# EasyEDA Pro project STM32F407VET6最小系统板.eprj, board STM32F407最小系统板_V02
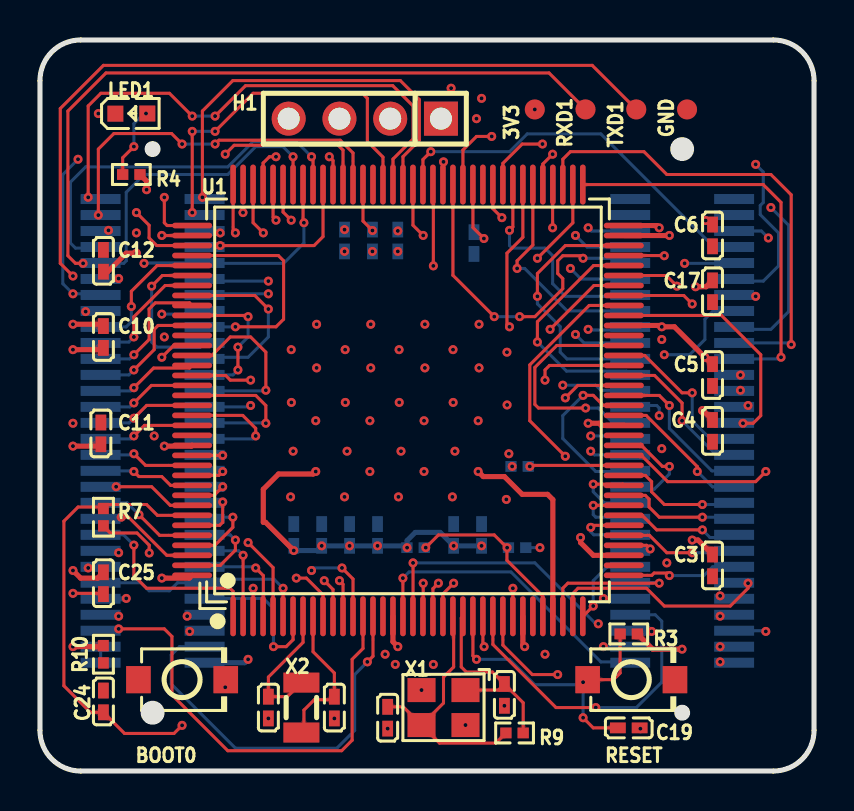
[diagram p2: board, top side]
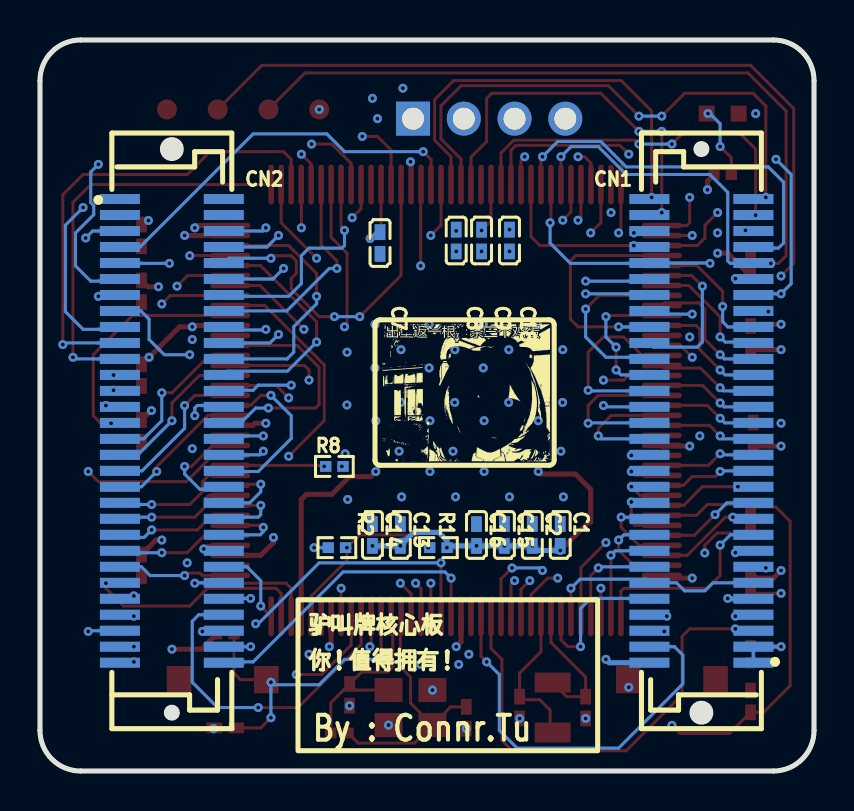
[diagram p3: board, bottom side, seen from below]

Outline 38.73 x 36.58 mm; copper layers: Top Layer, Inner1, Inner2, Bottom Layer. Coordinates in mm from the lower left corner of the outline.
Outline path: 0,34.54 0,2.03 arc(0.6,0.6) 2.03,0 36.7,0 arc(38.14,0.6) 38.73,2.03 38.73,34.54 arc(38.14,35.98) 36.7,36.58 2.03,36.58 arc(0.6,35.98) 0,34.54
Stack: Top Layer 0.035mm 外层铜厚1oz / Dielectric1 0.2104mm 7628 RC49% 8.6mil / Inner1 0.0152mm 内层铜厚 / Dielectric2 1.065mm 1.1mm H/HOZ 含铜 / Inner2 0.0152mm 内层铜厚 / Dielectric3 0.2104mm 7628 RC49% 8.6mil / Bottom Layer 0.035mm 外层铜厚1oz

## Design rules (mm)
template: 自定义配置
spacing copperThickness1oz (default): track to track 0.102, other pairs 0.152 to 0.3
spacing copperThickness2oz: track to track 0.203, other pairs 0.152 to 0.3
track width copperThickness1oz (default): min 0.09, default 0.152, max 2.54
track width copperThickness2oz: min 0.203, default 0.254, max 2.54
differential pair differentialPair (default): width min 0.127, default 0.254, max 2.54; gap min 0.152, default 0.152
via viaSize (default): diameter min 0.45, default 0.45, max 10; hole min 0.2, default 0.2, max 6.299
net GND uses 全铺
net VCC_3V3 uses 全铺
net $1N14408 uses 全铺

## Placement (name value [footprint] x y rotation side)
3V3  -  [test-point-0.5mm]  24.76 33.1 90 top
BOOT0  TS-1088R-02026  [SW-SMD_L3.9-W3.0-P4.45]  7.11 4.57 0 top
C1  100nF  [C0402]  12.7 11.81 270 bottom
C2  100nF  [C0402]  14.1 11.81 270 bottom
C3  100nF  [C0402]  33.66 10.29 90 top
C4  100nF  [C0402]  33.66 17.02 90 top
C5  100nF  [C0402]  33.66 19.81 90 top
C6  100nF  [C0402]  33.66 26.8 90 top
C7  100nF  [C0402]  21.72 26.42 90 bottom
C8  100nF  [C0402]  17.91 26.54 90 bottom
C9  100nF  [C0402]  16.64 26.54 90 bottom
C10  100nF  [C0402]  3.17 21.72 270 top
C11  100nF  [C0402]  3.05 16.89 270 top
C12  4.7uF  [C0402]  3.17 25.53 270 top
C13  1uF  [C0402]  20.7 11.81 270 bottom
C14  100nF  [C0402]  22.1 11.81 270 bottom
C15  1uF  [C0402]  15.49 11.81 270 bottom
C16  100nF  [C0402]  16.89 11.81 270 bottom
C17  2.2uF  [C0402]  33.66 24 90 top
C18  2.2uF  [C0402]  15.24 26.54 90 bottom
C19  100nF  [C0402]  29.46 2.16 0 top
C20  12pF  [C0402]  23.24 3.81 90 top
C21  12pF  [C0402]  17.4 2.67 90 top
C22  12pF  [C0402]  14.73 3.17 90 top
C23  12pF  [C0402]  11.43 3.17 90 top
C24  100nF  [C0402]  3.17 3.48 270 top
C25  100nF  [C0402]  3.17 9.4 90 top
CN1  X0802FVS-60AS-LPV01  [CONN-SMD_60P-P0.80_XKB_X0802FVS-60ADS-LPV01]  5.64 17.02 90 bottom
CN2  X0802FVS-60AS-LPV01  [CONN-SMD_60P-P0.80_XKB_X0802FVS-60ADS-LPV01]  32.14 17.02 270 bottom
GND  -  [test-point-0.5mm]  32.38 33.1 90 top
H1  PZ254V-11-04P  [HDR-TH_4P-P2.54-V-M]  16.26 32.64 180 top
LED1  XL-1608SURC-06  [LED0603-RD_RED]  4.57 32.89 0 top
R1  0Ω  [R0402]  18.8 11.18 180 bottom
R2  0Ω  [R0402]  23.88 11.18 0 bottom
R3  10kΩ  [R0402]  29.46 6.86 180 top
R4  10kΩ  [R0402]  4.57 29.84 180 top
R7  10kΩ  [R0402]  3.17 12.7 90 top
R8  10kΩ  [R0402]  24 15.24 0 bottom
R9  1MΩ  [R0402]  23.75 1.91 0 top
R10  10kΩ  [R0402]  3.17 5.84 90 top
RESET  TS-1088R-02026  [SW-SMD_L3.9-W3.0-P4.45]  29.59 4.57 0 top
RXD1  -  [test-point-0.5mm]  27.3 33.1 90 top
TXD1  -  [test-point-0.5mm]  29.84 33.1 90 top
U1  STM32F407ZET6  [LQFP-144_L20.0-W20.0-P0.50-LS22.0-BL]  18.41 18.54 0 top
X1  8MHz  [OSC-SMD_4P-L3.2-W2.5-BL]  20.19 3.17 180 top
X2  32.768kHz  [FC-135R_L3.2-W1.5]  13.08 3.17 270 top

## Footprints (pads in the part's own frame, mm; a bottom-side part is the same pattern mirrored in y, then rotated)
C0402
  rect 0.79x0.54 smd: 1(-0.545,0) 2(0.545,0)
CONN-SMD_60P-P0.80_XKB_X0802FVS-60ADS-LPV01
  rect 0.5x2 smd: 1(-11.6,-2.6) 2(-11.6,2.6) 3(-10.8,-2.6) 4(-10.8,2.6) 5(-10,-2.6) 6(-10,2.6) 7(-9.2,-2.6) 8(-9.2,2.6) 9(-8.4,-2.6) 10(-8.4,2.6) 11(-7.6,-2.6) 12(-7.6,2.6) 13(-6.8,-2.6) 14(-6.8,2.6) 15(-6,-2.6) 16(-6,2.6) 17(-5.2,-2.6) 18(-5.2,2.6) 19(-4.4,-2.6) 20(-4.4,2.6) 21(-3.6,-2.6) 22(-3.6,2.6) 23(-2.8,-2.6) 24(-2.8,2.6) 25(-2,-2.6) 26(-2,2.6) 27(-1.2,-2.6) 28(-1.2,2.6) 29(-0.4,-2.6) 30(-0.4,2.6) 31(0.4,-2.6) 32(0.4,2.6) 33(1.2,-2.6) 34(1.2,2.6) 35(2,-2.6) 36(2,2.6) 37(2.8,-2.6) 38(2.8,2.6) 39(3.6,-2.6) 40(3.6,2.6) 41(4.4,-2.6) 42(4.4,2.6) 43(5.2,-2.6) 44(5.2,2.6) 45(6,-2.6) 46(6,2.6) 47(6.8,-2.6) 48(6.8,2.6) 49(7.6,-2.6) 50(7.6,2.6) 51(8.4,-2.6) 52(8.4,2.6) 53(9.2,-2.6) 54(9.2,2.6) 55(10,-2.6) 56(10,2.6) 57(10.8,-2.6) 58(10.8,2.6) 59(11.6,-2.6) 60(11.6,2.6)
FC-135R_L3.2-W1.5
  rect 1x1.8 smd: 1(-1.25,0) 2(1.25,0)
HDR-TH_4P-P2.54-V-M
  rect 1.7x1.7 hole 1.1: 1(-3.81,0)
  round 1.7 hole 1.1: 2(-1.27,0) 3(1.27,0) 4(3.81,0)
LED0603-RD_RED
  rect 0.8x0.8 smd: 1(-0.799,-0.004) 2(0.799,0.004)
LQFP-144_L20.0-W20.0-P0.50-LS22.0-BL
  oval 0.28x2 smd: 1(-8.75,-10.8) 2(-8.25,-10.8) 3(-7.75,-10.8) 4(-7.25,-10.8) 5(-6.75,-10.8) 6(-6.25,-10.8) 7(-5.75,-10.8) 8(-5.25,-10.8) 9(-4.75,-10.8) 10(-4.25,-10.8) 11(-3.75,-10.8) 12(-3.25,-10.8) 13(-2.75,-10.8) 14(-2.25,-10.8) 15(-1.75,-10.8) 16(-1.25,-10.8) 17(-0.75,-10.8) 18(-0.25,-10.8) 19(0.25,-10.8) 20(0.75,-10.8) 21(1.25,-10.8) 22(1.75,-10.8) 23(2.25,-10.8) 24(2.75,-10.8) 25(3.25,-10.8) 26(3.75,-10.8) 27(4.25,-10.8) 28(4.75,-10.8) 29(5.25,-10.8) 30(5.75,-10.8) 31(6.25,-10.8) 32(6.75,-10.8) 33(7.25,-10.8) 34(7.75,-10.8) 35(8.25,-10.8) 36(8.75,-10.8) 73(8.75,10.8) 74(8.25,10.8) 75(7.75,10.8) 76(7.25,10.8) 77(6.75,10.8) 78(6.25,10.8) 79(5.75,10.8) 80(5.25,10.8) 81(4.75,10.8) 82(4.25,10.8) 83(3.75,10.8) 84(3.25,10.8) 85(2.75,10.8) 86(2.25,10.8) 87(1.75,10.8) 88(1.25,10.8) 89(0.75,10.8) 90(0.25,10.8) 91(-0.25,10.8) 92(-0.75,10.8) 93(-1.25,10.8) 94(-1.75,10.8) 95(-2.25,10.8) 96(-2.75,10.8) 97(-3.25,10.8) 98(-3.75,10.8) 99(-4.25,10.8) 100(-4.75,10.8) 101(-5.25,10.8) 102(-5.75,10.8) 103(-6.25,10.8) 104(-6.75,10.8) 105(-7.25,10.8) 106(-7.75,10.8) 107(-8.25,10.8) 108(-8.75,10.8)
  oval 2x0.28 smd: 37(10.8,-8.75) 38(10.8,-8.25) 39(10.8,-7.75) 40(10.8,-7.25) 41(10.8,-6.75) 42(10.8,-6.25) 43(10.8,-5.75) 44(10.8,-5.25) 45(10.8,-4.75) 46(10.8,-4.25) 47(10.8,-3.75) 48(10.8,-3.25) 49(10.8,-2.75) 50(10.8,-2.25) 51(10.8,-1.75) 52(10.8,-1.25) 53(10.8,-0.75) 54(10.8,-0.25) 55(10.8,0.25) 56(10.8,0.75) 57(10.8,1.25) 58(10.8,1.75) 59(10.8,2.25) 60(10.8,2.75) 61(10.8,3.25) 62(10.8,3.75) 63(10.8,4.25) 64(10.8,4.75) 65(10.8,5.25) 66(10.8,5.75) 67(10.8,6.25) 68(10.8,6.75) 69(10.8,7.25) 70(10.8,7.75) 71(10.8,8.25) 72(10.8,8.75) 109(-10.8,8.75) 110(-10.8,8.25) 111(-10.8,7.75) 112(-10.8,7.25) 113(-10.8,6.75) 114(-10.8,6.25) 115(-10.8,5.75) 116(-10.8,5.25) 117(-10.8,4.75) 118(-10.8,4.25) 119(-10.8,3.75) 120(-10.8,3.25) 121(-10.8,2.75) 122(-10.8,2.25) 123(-10.8,1.75) 124(-10.8,1.25) 125(-10.8,0.75) 126(-10.8,0.25) 127(-10.8,-0.25) 128(-10.8,-0.75) 129(-10.8,-1.25) 130(-10.8,-1.75) 131(-10.8,-2.25) 132(-10.8,-2.75) 133(-10.8,-3.25) 134(-10.8,-3.75) 135(-10.8,-4.25) 136(-10.8,-4.75) 137(-10.8,-5.25) 138(-10.8,-5.75) 139(-10.8,-6.25) 140(-10.8,-6.75) 141(-10.8,-7.25) 142(-10.8,-7.75) 143(-10.8,-8.25) 144(-10.8,-8.75)
OSC-SMD_4P-L3.2-W2.5-BL
  rect 1.4x1.2 smd: 1(-1.1,-0.875) 2(1.1,-0.875) 3(1.1,0.875) 4(-1.1,0.875)
R0402
  rect 0.566x0.54 smd: 1(-0.433,0) 2(0.433,0)
SW-SMD_L3.9-W3.0-P4.45
  rect 1.23x1.36 smd: 1(-2.185,0) 2(2.185,0)
test-point-0.5mm
  round 1 smd: 1(0,0)

## Nets
As in the schematic, except:
GND: C1.1 C2.1 C3.1 C4.1 C5.1 C6.1 C7.1 C8.1 C9.1 C10.1 C11.1 C12.1 C13.1 C14.1 C15.1 C16.1 C17.1 C18.1 C19.2 C20.1 C21.1 C22.1 C23.1 C25.1 CN2.1 CN2.2 CN2.3 CN2.4 GND.1 H1.4 LED1.1 R7.1 R8.1 RESET.2 U1.16 U1.31 U1.38 U1.51 U1.61 U1.83 U1.94 U1.107 U1.120 U1.130 X1.2 X1.4
VCC_3V3: 3V3.1 C1.2 C2.2 C3.2 C4.2 C5.2 C6.2 C7.2 C8.2 C9.2 C10.2 C11.2 C12.2 C13.2 C14.2 C15.2 C16.2 C17.2 C18.2 C25.2 CN1.1 CN1.2 CN1.3 H1.1 R1.2 R3.1 R4.1 R10.2 U1.17 U1.30 U1.33 U1.39 U1.52 U1.62 U1.71 U1.72 U1.84 U1.95 U1.106 U1.108 U1.121 U1.131 U1.144
BOOT0: BOOT0.2 C24.2 R7.2 U1.138
RESET: C19.1 R3.2 RESET.1 U1.25
$1N14408: BOOT0.1 C24.1 R10.1

## Via types
v1: diameter 0.45, hole 0.2, Top Layer to Bottom Layer, 282 vias

## Routing (per net, layer and track width the routed paths; a pad name or vN(x,y) marks a point on that pad's centre or on a via; arc(x,y) is an arc through that point)
GND: length 6.2
  Top Layer w0.152: C25.1 3.14,8.89 v1(1.65,8.89) ; R7.1 3.17,12.25 3.52,11.91 4.86,11.91 5.47,11.3 v1(5.47,10.91)
  Top Layer w0.254: C10.1 3.09,22.35 v1(1.65,22.35)
  vias: v1(1.65,17.4) v1(2.92,32.89) v1(4.83,26.92) v1(5.72,16.76) v1(6.22,21.72) v1(10.16,27.94) v1(11.43,2.63) v1(12.57,21.08) v1(12.58,18.44) v1(12.54,13.72) v1(12.67,16) v1(14.73,2.63) v1(15.24,26) v1(15.27,21.08) v1(15.28,18.44) v1(15.24,13.72) v1(15.37,16) v1(16.64,26) v1(17.27,5.84) v1(17.4,2.12) v1(17.78,5.33) v1(17.91,26) v1(17.97,21.08) v1(17.98,18.44) v1(17.94,13.72) v1(18.07,16) v1(19.09,4.05) v1(19.69,5.33) v1(20.67,21.08) v1(20.68,18.44) v1(20.64,13.72) v1(20.76,16) v1(21.29,2.3) v1(23.24,3.27) v1(23.37,20.95) v1(23.38,18.31) v1(23.34,13.59) v1(23.46,15.88) v1(23.63,15.24) v1(25.27,5.84) v1(30.04,2.12) v1(31.12,21.59) v1(31.12,16.13) v1(31.37,10.41)
VBAT: length 11.1
  Top Layer w0.152: v1(12.16,9.14) 12.16,7.74
  Bottom Layer w0.152: v1(12.16,9.14) 11.71,9.6 8.42,9.6 8.24,9.42 6.88,9.42 6.48,9.02 5.46,9.02 5.06,9.42 3.04,9.42
VCC_3V3: length 80.5
  Top Layer w0.152: U1.108 9.66,27.04 v1(9.78,26.92) ; 7.62,21.29 6.69,21.29 v1(6.1,20.7) ; U1.95 16.16,27.52 v1(16.64,27.04) ; v1(11.18,26.92) 10.66,27.44 U1.106 ; U1.84 21.66,27.19 v1(22.22,26.64)
  Top Layer w0.254: v1(32.81,24.23) 33.34,24.23 C17.2 ; C5.2 33.62,20.36 v1(33.27,20.7) 31.75,22.22 v1(31.12,22.22) 31.05,22.29 U1.62 ; 25.66,7.74 25.66,13.58 25.4,13.84 24.13,13.84 23.24,14.73 22.18,14.73 v1(21.93,14.99) ; R3.1 30.66,6.1 v1(32.13,6.1) ; v1(24.26,6.22) 24.16,6.31 24.16,7.74 ; v1(17.91,6.22) 17.66,6.47 17.66,7.74 ; U1.52 28.09,17.29 27.98,17.4 v1(27.43,17.4) ; C4.2 33.18,18.03 v1(33.16,18.03) ; 7.62,9.79 7.47,9.65 v1(6.1,9.65) ; v1(1.65,21.08) 3.09,21.08 C10.2 ; 7.62,16.29 7.58,16.26 v1(6.22,16.26) ; v1(33.31,27.54) 33.45,27.54 C6.2 ; v1(12.7,11.03) 11.28,12.45 11.18,12.45 11.18,14.1 11.94,14.86 13.67,14.86 v1(13.8,14.99) ; v1(27.05,11.68) 27.05,11.43 27.69,10.79 U1.39 ; v1(1.65,6.22) 3.12,6.22 R10.2 ; v1(30.99,27.18) 30.87,27.29 U1.72 ; v1(31.5,26.8) 31.49,26.79 U1.71 ; C12.2 3.39,24.98 4.32,25.91 v1(4.83,25.91) ; C25.2 2.88,9.65 2.03,9.65 v1(1.65,10.03) ; v1(32.64,11.56) 32.93,11.56 C3.2 ; v1(5.33,29.08) 5.33,29.52 R4.1 ; v1(1.65,16.26) 2.96,16.26 C11.2
  Inner1 w0.254: 30.99,22.86 31.12,22.73 v1(31.12,22.22)
  Bottom Layer w0.152: v1(22.22,26.64) 21.9,26.96 C7.2 ; 3.04,5.42 CN1.3 3.03,6.22 v1(1.65,6.22)
  Bottom Layer w0.254: v1(10.41,5.59) 10.24,5.42 8.24,5.42 ; v1(18.37,11.18) 18.37,11.53 18.78,11.94 20.03,11.94 v1(20.7,11.27) v1(22.1,11.27) ; R1.2 18.27,11.27 v1(16.89,11.27) v1(15.49,11.27) v1(14.1,11.27) 13.86,11.03 v1(12.7,11.03)
  vias: v1(13.84,22.35) v1(13.84,20.17) v1(13.8,17.53) v1(15.24,27.09) v1(16.55,22.35) v1(16.55,20.17) v1(16.51,17.53) v1(16.51,14.99) v1(17.91,27.02) v1(19.26,22.35) v1(19.26,20.17) v1(19.22,17.53) v1(19.22,14.99) v1(20.57,34.16) v1(21.84,32.64) v1(21.97,22.35) v1(21.97,20.17) v1(21.93,17.53) v1(22.1,33.66) v1(24.76,33.1)
BOOT0: length 26
  Top Layer w0.152: 7.11,2.41 v1(7.11,2.29) 6.71,1.88 4.23,1.88 C24.2 2.52,2.94 1.2,4.26 1.2,12.5 1.91,13.21 3.1,13.21 R7.2 3.38,13.33 5.33,13.33 5.88,12.79 7.62,12.79
  Inner2 w0.254: v1(9.27,4.19) 9.27,3.3 8.25,2.29 v1(7.11,2.29)
BOOT1: length 4.7
  Top Layer w0.152: U1.48 24.56,15.29 v1(24.51,15.24)
OSC32_IN: length 6.7
  Top Layer w0.152: X2.1 12.38,3.72 C23.2 11.43,4.7 13.16,6.43 13.16,7.74
OSC32_OUT: length 7.4
  Top Layer w0.152: 13.66,7.74 13.66,5.97 14.73,4.9 C22.2 14.58,3.57 13.73,3.57 13.21,3.05 13.21,2.05 X2.2
OSC_IN: length 13
  Top Layer w0.152: 20.66,7.74 20.7,7.71 20.7,5.21 20.19,4.7 20.19,3.4 X1.3 ; X1.3 20,1.4 22.81,1.4 R9.1 ; X1.3 18.18,3.21 C21.2
OSC_OUT: length 10
  Top Layer w0.152: 21.16,7.74 21.08,7.66 21.08,5.21 21.34,4.95 22.64,4.95 C20.2 ; C20.2 24.18,3.41 R9.2 ; C20.2 22.94,4.05 X1.1
PA0: length 7.5
  Top Layer w0.152: 30.73,9.4 26.42,9.4 26.16,9.15 26.16,7.74
  Bottom Layer w0.152: v1(30.99,9.4) 30.97,9.42 29.54,9.42
PA1: length 11
  Top Layer w0.152: v1(35.43,9.4) 35.43,9.14 34.54,8.25 31.24,8.25 30.35,9.14 26.92,9.14 26.66,8.88 26.66,7.74
PA2: length 4.2
  Top Layer w0.152: v1(27.69,8.25) 27.18,7.75 27.18,7.73 27.16,7.74
  Bottom Layer w0.152: CN2.48 28.38,10.22 27.69,9.52 v1(27.69,8.25)
PA3: length 5.8
  Top Layer w0.152: U1.37 30.62,9.79 30.73,9.91 31.37,9.91 v1(31.5,9.78)
  Bottom Layer w0.152: CN2.47 33.66,10.22 33.22,9.78 v1(31.5,9.78)
PA4: length 2.4
  Top Layer w0.152: 30.48,11.18 30.36,11.29 U1.40
  Bottom Layer w0.152: v1(30.54,11.11) 30.44,11.02 CN2.46
PA5: length 5.9
  Top Layer w0.152: U1.41 30.5,11.79 31.37,10.92 v1(32.64,10.92)
  Bottom Layer w0.152: v1(32.64,10.92) 34.64,10.92 CN2.45
PA6: length 4
  Top Layer w0.152: U1.42 27.66,12.29 v1(27.56,12.19)
  Bottom Layer w0.152: CN2.44 27.71,11.82 27.56,11.97 v1(27.56,12.19)
PA7: length 6
  Top Layer w0.152: U1.43 30.13,12.79 30.86,12.06 v1(33.15,12.06)
  Bottom Layer w0.152: CN2.43 34.6,11.68 33.53,11.68 v1(33.15,12.06)
PA8: length 19.3
  Top Layer w0.152: v1(13.59,30.73) 13.66,30.66 U1.100
  Bottom Layer w0.152: CN1.53 2.98,26.16 1.78,26.16 1.52,26.42 1.52,29.46 2.29,30.23 9.4,30.23 10.67,31.5 12.83,31.5 v1(13.59,30.73)
PA9: length 55.2
  Top Layer w0.152: v1(1.65,24.77) 1.02,25.4 1.02,33.15 3.17,35.31 27.63,35.31 TXD1.1 ; v1(13.21,27.43) 13.16,27.47 U1.101
  Inner1 w0.254: v1(1.65,24.77) 2.41,24 4.04,24 5.21,25.17 v1(5.21,25.4)
  Bottom Layer w0.152: v1(13.21,27.43) 13.21,26.42 12.19,25.4 8.25,25.4 8.24,25.42 5.22,25.42 v1(5.21,25.4)
PA10: length 51.3
  Top Layer w0.152: RXD1.1 25.48,34.92 3.3,34.92 1.4,33.02 1.4,25.78 1.78,25.4 v1(2.16,25.4) ; U1.102 v1(12.66,30.73)
  Bottom Layer w0.152: 3.04,25.42 3.05,25.4 4.19,25.4 4.32,25.53 4.32,28.96 5.21,29.84 9.4,29.84 10.79,31.24 12.16,31.24 v1(12.66,30.73)
PA11: length 8.9
  Top Layer w0.152: v1(12.57,27.56) 12.16,27.97 U1.103
  Inner2 w0.254: v1(11.43,24.51) 11.81,24.51 12.57,25.27 v1(12.57,27.56)
  Bottom Layer w0.152: CN1.50 8.34,24.51 v1(11.43,24.51)
PA12: length 11.8
  Top Layer w0.152: U1.104 11.66,27.7 v1(11.81,27.56)
  Inner2 w0.254: v1(11.81,27.56) 11.81,26.03 10.67,24.89 4.19,24.89 v1(3.94,24.64)
PA15: length 7.7
  Top Layer w0.152: v1(6.1,26.8) 6.1,26.79 7.62,26.79
  Inner1 w0.254: v1(6.1,22.86) v1(6.1,26.8)
  Bottom Layer w0.152: v1(6.1,22.86) 8.08,22.86 CN1.46
PB0: length 4
  Top Layer w0.152: U1.46 29.16,14.35 v1(27.69,14.35)
  Bottom Layer w0.152: v1(27.69,14.35) 27.69,13.97 28.24,13.42 29.54,13.42
PB1: length 6.5
  Top Layer w0.152: v1(33.15,13.33) 31.24,13.33 30.61,13.97 30.61,14.48 30.29,14.79 U1.47
  Bottom Layer w0.152: 34.74,13.42 34.65,13.33 v1(33.15,13.33)
PB3: length 4.8
  Top Layer w0.152: v1(4.7,15.88) 5.28,15.29 7.62,15.29
  Bottom Layer w0.152: CN1.27 4.64,15.82 v1(4.7,15.88)
PB4: length 1.6
  Top Layer w0.152: v1(9.14,14.99) 8.95,14.79 7.62,14.79
PB5: length 4.9
  Top Layer w0.152: v1(4.7,14.99) 4.95,14.73 6.1,14.73 6.54,14.29 7.62,14.29
  Bottom Layer w0.152: v1(4.7,14.99) 4.67,15.02 CN1.25
PB6: length 1.7
  Top Layer w0.152: v1(9.14,14.22) 8.71,13.79 7.62,13.79
PB7: length 4.2
  Top Layer w0.152: 7.62,13.29 6.52,13.29 5.59,14.22 v1(3.81,14.22)
PB8: length 2.6
  Top Layer w0.152: 7.62,12.29 8.99,12.29 9.14,12.45 v1(9.14,13.46)
PB9: length 5.3
  Top Layer w0.152: 7.62,11.79 5.99,11.79 v1(4.95,12.83)
  Bottom Layer w0.152: 3.04,13.42 4.36,13.42 v1(4.95,12.83)
PB10: length 10.9
  Top Layer w0.152: U1.69 31.23,25.79 v1(31.24,25.78)
  Inner1 w0.254: v1(31.24,25.78) 31.37,25.65 31.37,24 32,23.37 32,20.83 33.15,19.69 34.92,19.69 v1(35.05,19.81)
PB11: length 13
  Top Layer w0.152: v1(24.89,23.75) 24.89,24.89 26.29,26.29 U1.70
  Bottom Layer w0.152: v1(24.89,23.75) 24.89,23.37 26.03,22.23 26.03,20.95 26.37,20.62 CN2.22
PB12: length 20.4
  Top Layer w0.152: v1(37.08,20.7) 37.08,28.45 36.19,29.34 U1.73
  Bottom Layer w0.152: CN2.21 37,20.62 v1(37.08,20.7)
PB13: length 11.9
  Top Layer w0.152: v1(24.89,25.65) 26.66,27.43 U1.74
  Inner2 w0.254: v1(24.89,25.65) 24.89,25.02 26.42,23.49 26.42,22.22 v1(26.8,21.84)
  Bottom Layer w0.152: 29.54,21.42 27.22,21.42 v1(26.8,21.84)
PB14: length 24.1
  Top Layer w0.152: v1(37.59,21.34) 37.59,28.83 36.58,29.84 31.37,29.84 30.23,30.99 26.54,30.99 26.16,30.61 U1.75
  Bottom Layer w0.152: v1(37.59,21.34) 37.51,21.42 34.74,21.42
PB15: length 10.2
  Top Layer w0.152: U1.76 25.65,29.33 v1(25.65,27.18)
  Inner1 w0.254: v1(27.43,22.1) 25.65,23.88 v1(25.65,27.18)
  Bottom Layer w0.152: v1(27.43,22.1) 27.46,22.07 29.38,22.07 CN2.18
PC0: length 20.6
  Top Layer w0.152: 22.16,7.74 22.16,6.35
  Inner2 w0.254: v1(36.32,6.98) 36.32,4.83 35.43,3.94 25.78,3.94 23.62,6.1 22.35,6.1 v1(22.22,6.22)
  Bottom Layer w0.152: v1(36.32,6.98) 36.29,7.02 CN2.55
PC1: length 16.5
  Top Layer w0.152: 22.66,7.74 22.66,6.33 25.82,3.17 v1(27.81,3.17)
  Bottom Layer w0.152: v1(27.81,3.17) 29.84,3.17 31.12,4.44 31.12,7.49 30.79,7.82 CN2.54
PC2: length 14.9
  Top Layer w0.152: 23.16,7.74 23.16,6.3 24.64,4.83 25.78,4.83
  Inner1 w0.254: v1(25.91,4.83) 26.26,5.18 32.36,5.18 33.15,5.97 33.15,7.49 33.4,7.75 v1(34.04,7.75)
PC3: length 7.5
  Top Layer w0.152: 23.66,7.74 v1(23.66,9.14)
  Inner2 w0.254: v1(28.19,8.64) 27.69,9.14 v1(23.66,9.14)
  Bottom Layer w0.152: CN2.52 29.52,8.64 v1(28.19,8.64)
PC4: length 3.9
  Top Layer w0.152: U1.44 v1(27.69,13.29)
  Bottom Layer w0.152: v1(27.69,13.29) 27.69,12.83 27.81,12.7 29.45,12.7 CN2.42
PC5: length 6.2
  Top Layer w0.152: v1(33.15,12.7) 30.99,12.7 30.48,13.21 30.48,13.6 30.29,13.79 U1.45
  Bottom Layer w0.152: v1(33.15,12.7) 34.65,12.7 CN2.41
PC6: length 18.5
  Top Layer w0.152: v1(2.92,27.81) 2.92,31.11 3.7,31.89 6.59,31.89 v1(7.11,31.37) ; v1(8.76,31.37) 8.95,31.56 15.03,31.56 15.66,30.92 U1.96
  Bottom Layer w0.152: v1(7.11,31.37) v1(8.76,31.37)
PC7: length 11.9
  Top Layer w0.152: U1.97 15.16,31.06 14.92,31.31 9.72,31.31 v1(9.27,30.86)
  Inner2 w0.254: v1(9.02,26.92) 9.27,27.18 v1(9.27,30.86)
PC8: length 20.7
  Top Layer w0.152: U1.98 14.66,30.55 v1(14.48,30.73)
  Inner2 w0.254: v1(3.43,27.05) 3.43,32.38 4.83,33.78 13.08,33.78 13.72,33.15 13.72,31.5 v1(14.48,30.73)
PC9: length 7.9
  Top Layer w0.152: U1.99 14.16,26.74 13.72,26.29 v1(9.02,26.29)
PC10: length 15.8
  Top Layer w0.152: 7.62,26.29 5.84,26.29 5.46,26.67 5.46,27.3 v1(4.83,27.94)
  Inner1 w0.254: v1(4.83,27.94) 4.06,27.94 2.54,29.46 1.27,29.46 0.89,29.08 0.89,23.49 1.4,22.99 v1(2.29,22.99)
PC11: length 11.7
  Top Layer w0.152: 7.62,25.79 11.93,25.79 12.19,25.53 12.19,22.61 11.81,22.22 v1(9.78,22.22)
  Bottom Layer w0.152: v1(9.78,22.22) 9.77,22.22 CN1.44
PC12: length 6.7
  Top Layer w0.152: v1(4.57,23.24) 4.57,24 5.86,25.29 7.62,25.29
  Bottom Layer w0.152: CN1.43 4.31,22.22 4.57,22.48 v1(4.57,23.24)
PC13: length 7.9
  Top Layer w0.152: 12.66,7.74 12.66,6.57 12.32,6.22 v1(11.68,6.22)
  Bottom Layer w0.152: v1(11.68,6.22) 11.68,8.13 11.18,8.64 8.25,8.64 CN1.10
PD0: length 7.9
  Top Layer w0.152: 7.62,24.79 6.12,24.79 v1(5.59,24.26)
  Bottom Layer w0.152: v1(5.59,24.26) 5.59,21.46 5.84,21.21 8.03,21.21 8.24,21.42
PD1: length 6.4
  Top Layer w0.152: 7.62,24.29 6.26,24.29 4.7,22.73 v1(4.7,21.72)
  Bottom Layer w0.152: 3.04,21.42 3.08,21.46 4.44,21.46 v1(4.7,21.72)
PD2: length 9.1
  Top Layer w0.152: 7.62,23.79 10.75,23.79 v1(11.43,23.11)
  Bottom Layer w0.152: CN1.40 8.32,20.7 10.41,20.7 11.43,21.72 v1(11.43,23.11)
PD3: length 6.7
  Top Layer w0.152: v1(4.7,20.83) 5.46,21.59 5.46,23.11 5.77,23.42 7.48,23.42 7.62,23.29
  Bottom Layer w0.152: CN1.39 4.49,20.62 v1(4.7,20.83)
PD4: length 7.5
  Top Layer w0.152: v1(10.41,22.73) 10.35,22.79 7.62,22.79 ; v1(9.91,20.07) v1(9.91,21.21)
  Bottom Layer w0.152: v1(9.91,21.21) 10.41,21.72 v1(10.41,22.73) ; CN1.38 9.66,19.82 v1(9.91,20.07)
PD5: length 6.2
  Top Layer w0.152: v1(4.7,20.07) 5.72,21.08 5.72,22.1 5.91,22.29 7.62,22.29
  Bottom Layer w0.152: CN1.37 4.45,19.82 v1(4.7,20.07)
PD6: length 9.4
  Top Layer w0.152: 7.62,20.79 8.6,20.79 9.53,21.72 10.54,21.72 11.3,20.95 v1(11.3,19.05)
  Bottom Layer w0.152: v1(11.3,19.05) 11.27,19.02 CN1.36
PD7: length 5.1
  Top Layer w0.152: v1(4.7,19.18) 5.68,20.16 7.48,20.16 7.62,20.29
  Bottom Layer w0.152: v1(4.7,19.18) 4.54,19.02 CN1.35
PD8: length 22.5
  Top Layer w0.152: v1(25.65,30.86) 25.16,30.37 U1.77
  Inner2 w0.254: v1(36.58,28.19) 34.92,29.84 30.86,29.84 29.84,30.86 v1(25.65,30.86)
  Bottom Layer w0.152: v1(36.58,28.19) 37.47,27.3 37.47,22.99 36.58,22.1 34.86,22.1 CN2.17
PD9: length 11.1
  Top Layer w0.152: v1(23.88,25.15) 23.88,25.53 24.66,26.32 U1.78
  Bottom Layer w0.152: CN2.16 26.38,23.02 24.26,25.15 v1(23.88,25.15)
PD10: length 21.5
  Top Layer w0.152: U1.79 24.16,26.7 23.37,25.91 23.37,22.35 v1(23.5,22.22)
  Inner1 w0.254: v1(23.5,22.22) 23.5,22.13 25.56,20.07 30.48,20.07 v1(31.24,20.83)
  Bottom Layer w0.152: v1(31.24,20.83) 32.51,20.83 33.27,21.59 33.27,22.61 33.69,23.02 CN2.15
PD11: length 11.1
  Top Layer w0.152: v1(23.5,27.05) 23.66,27.22 U1.80
  Bottom Layer w0.152: v1(23.5,27.05) 23.5,26.29 23.62,26.16 25.27,26.16 25.65,25.78 25.65,24.38 26.29,23.75 29.47,23.75 CN2.14
PD12: length 21.5
  Top Layer w0.152: U1.81 23.16,30.4 24.13,31.37 v1(25.15,31.37)
  Inner1 w0.254: v1(35.81,23.75) 35.81,27.05 36.07,27.3 36.07,28.45 34.42,30.09 31.53,30.09 30.25,31.37 v1(25.15,31.37)
  Bottom Layer w0.152: CN2.13 35.75,23.82 v1(35.81,23.75)
PD13: length 9.5
  Top Layer w0.152: v1(23.11,27.69) 22.66,28.13 U1.82
  Inner2 w0.254: v1(26.54,25.15) 24,27.69 v1(23.11,27.69)
  Bottom Layer w0.152: v1(26.54,25.15) 27.07,24.62 CN2.12
PD14: length 25.9
  Top Layer w0.152: U1.85 21.16,31.07 21.84,31.75 v1(22.61,31.75)
  Inner2 w0.254: v1(35.81,30.35) 34.92,30.35 33.02,32.26 31.5,32.26 31.12,31.88 22.73,31.88 v1(22.61,31.75)
  Bottom Layer w0.152: v1(35.81,30.35) 36.19,29.97 36.19,28.45 36.04,28.3 36.04,27.84 36.96,26.92 36.96,25.27 36.19,24.51 34.84,24.51 CN2.11
PD15: length 16.9
  Top Layer w0.152: v1(27.18,25.65) 27.05,25.78 26.16,25.78 25.91,25.53 25.91,24.89 26.16,24.64 26.16,24.13 24.76,22.73 v1(24,22.73) ; v1(22.73,22.73) 20.66,24.8 U1.86
  Bottom Layer w0.152: 29.54,25.42 29.3,25.65 v1(27.18,25.65) ; v1(22.73,22.73) v1(24,22.73)
PDR_ON: length 4.6
  Top Layer w0.152: 7.62,10.29 9.02,10.29 9.78,11.05 v1(9.78,11.56)
  Bottom Layer w0.152: CN1.18 9.52,11.82 v1(9.78,11.56)
PE0: length 4.4
  Top Layer w0.152: 7.62,11.29 8.75,11.29 9.65,12.19 v1(9.65,12.7)
  Bottom Layer w0.152: v1(9.65,12.7) 8.32,12.7 CN1.20
PE1: length 5.4
  Top Layer w0.152: 7.62,10.79 6.35,10.79 4.44,12.7 v1(4.06,12.7)
  Bottom Layer w0.152: v1(4.06,12.7) 3.98,12.62 CN1.19
PE2: length 9.9
  Top Layer w0.152: v1(4.7,11.3) 4.7,9.78 5.33,9.14 9.51,9.14 9.66,8.99 9.66,7.74
  Bottom Layer w0.152: v1(4.7,11.3) 4.18,11.82 CN1.17
PE3: length 5.1
  Top Layer w0.152: 10.16,7.74 v1(10.16,10.8)
  Bottom Layer w0.152: CN1.16 9.94,11.02 v1(10.16,10.8)
PE4: length 8.9
  Top Layer w0.152: 10.66,7.74 10.67,7.74 v1(10.67,9.14)
  Inner2 w0.254: v1(3.94,10.92) 4.7,10.16 9.65,10.16 v1(10.67,9.14)
PE5: length 5.2
  Top Layer w0.152: v1(10.79,10.16) 11.18,9.78 11.18,7.75 11.16,7.74
  Bottom Layer w0.152: v1(10.79,10.16) 10.74,10.22 CN1.14
PE6: length 13.8
  Top Layer w0.152: 11.66,7.74 11.66,10.18 v1(10.41,11.43)
  Inner2 w0.254: v1(2.41,10.16) 2.41,10.8 3.68,12.06 10.13,12.06 10.41,11.78 v1(10.41,11.43)
PE7: length 11.4
  Top Layer w0.152: v1(25.27,19.56) 25.27,20.07 25.5,20.29 U1.58
  Inner1 w0.254: v1(27.56,16.76) 25.78,16.76 25.27,17.27 v1(25.27,19.56)
  Bottom Layer w0.152: v1(27.56,16.76) 29.39,16.76 CN2.32
PE8: length 8.1
  Top Layer w0.152: U1.59 30.26,20.79 32.13,18.92 v1(32.64,18.92)
  Bottom Layer w0.152: v1(32.64,18.92) 32.64,17.53 33.55,16.62 CN2.31
PE9: length 11.9
  Top Layer w0.152: v1(27.31,18.16) 24.95,18.16 24.77,18.34 24.76,20.19 25.86,21.29 U1.60
  Bottom Layer w0.152: 29.54,17.42 28.68,17.42 27.94,18.16 v1(27.31,18.16)
PE10: length 11.8
  Top Layer w0.152: U1.63 34.1,22.79 36.07,20.83 36.07,17.78 35.69,17.4 v1(35.18,17.4)
PE11: length 19
  Top Layer w0.152: v1(26.29,15.75) 24.51,17.53 24.51,20.32 27.48,23.29 U1.64
  Inner1 w0.254: v1(30.99,17.78) 28.6,15.4 26.64,15.4 v1(26.29,15.75)
  Bottom Layer w0.152: v1(30.99,17.78) 30.99,18.16 30.86,18.29 29.61,18.29 CN2.28
PE12: length 11.7
  Top Layer w0.152: v1(32.64,23.37) 32.22,23.79 U1.65
  Inner1 w0.254: v1(32.64,23.37) 33.4,22.61 35.69,22.61 36.07,22.22 36.07,18.92 v1(35.43,18.29)
PE13: length 11.1
  Top Layer w0.152: U1.66 27.72,24.29 v1(25.53,22.1)
  Inner2 w0.254: v1(25.53,22.1) 25.53,21.46 25.78,21.21 25.78,19.69 v1(26.16,19.3)
  Bottom Layer w0.152: v1(26.16,19.3) 27.81,19.3 28.07,19.05 29.5,19.05 CN2.26
PE14: length 12.2
  Top Layer w0.152: U1.67 31.34,24.79 v1(31.88,24.26)
  Inner2 w0.254: v1(31.88,24.26) 31.88,22.86 32.89,21.84 35.43,21.84 36.07,21.21 36.07,19.3 35.81,19.05 v1(35.05,19.05)
PE15: length 11.8
  Top Layer w0.152: U1.68 27.7,25.29 24.89,22.48 v1(24.89,21.46)
  Bottom Layer w0.152: CN2.24 29.35,20.01 26.35,20.01 v1(24.89,21.46)
PF0: length 13.3
  Top Layer w0.152: v1(12.83,9.65) 13.33,9.65 14.16,8.82 14.16,7.74
  Inner2 w0.254: v1(4.32,8.64) 4.7,8.25 10.54,8.25 11.94,9.65 v1(12.83,9.65)
  Bottom Layer w0.254: CN1.9 4.3,8.62 v1(4.32,8.64)
PF1: length 9.6
  Top Layer w0.152: 14.66,7.74 14.66,9.08 v1(14.22,9.52)
  Inner2 w0.254: v1(14.22,9.52) 13.59,9.52 11.81,7.75 v1(7.37,7.75)
PF2: length 16.7
  Top Layer w0.152: 15.16,7.74 15.16,9.35 v1(14.99,9.52)
  Inner1 w0.254: v1(3.94,7.75) 4.06,7.62 6.22,7.62 6.86,8.25 6.86,9.65 9.27,12.06 12.45,12.06 v1(14.99,9.52)
PF3: length 11.9
  Top Layer w0.152: v1(15.11,10.16) 15.66,9.61 15.66,7.74
  Inner1 w0.254: v1(13.59,10.03) 13.59,9.52 11.05,6.98 v1(7.49,6.98)
  Bottom Layer w0.152: v1(13.59,10.03) 13.72,10.16 v1(15.11,10.16)
PF4: length 22.6
  Top Layer w0.152: 16.16,7.74 16.16,6.13 15.62,5.59 15.62,1.54 15.1,1.02 9.4,1.02 6.6,3.81 6.6,6.73 6.22,7.11 v1(3.94,7.11)
PF5: length 20.3
  Top Layer w0.152: 16.66,7.74 16.66,5.74 v1(16.38,5.46)
  Bottom Layer w0.152: v1(16.38,5.46) 15.75,4.83 15.75,2.03 14.86,1.14 9.78,1.14 6.57,4.36 6.57,5.8 6.98,6.22 6.99,6.22 CN1.4
PF6: length 15.3
  Top Layer w0.152: 18.16,7.74 18.16,7.75 v1(18.16,9.65)
  Bottom Layer w0.152: 29.54,5.42 29.49,5.46 28.07,5.46 23.57,9.96 18.47,9.96 v1(18.16,9.65)
PF7: length 20.1
  Top Layer w0.152: v1(18.67,10.41) 18.67,7.75 18.66,7.74
  Inner2 w0.254: v1(27.94,7.37) 29.84,5.46 v1(34.04,5.46)
  Bottom Layer w0.152: v1(18.67,10.41) 24.76,10.41 27.94,7.24
PF8: length 14.1
  Top Layer w0.152: 19.16,7.74 19.18,7.75 v1(19.18,9.4)
  Inner1 w0.254: v1(19.18,9.4) 19.94,10.16 24.43,10.16 28.19,6.4 v1(28.19,6.22)
  Bottom Layer w0.152: v1(28.19,6.22) 29.53,6.22 CN2.58
PF9: length 17.9
  Top Layer w0.152: 19.66,7.74 19.66,9.12 v1(19.94,9.4)
  Inner2 w0.254: v1(34.04,6.22) 32.89,6.22 28.83,10.29 20.83,10.29 v1(19.94,9.4)
PF10: length 14.2
  Top Layer w0.152: v1(20.7,9.4) 20.16,8.86 20.16,7.74
  Inner2 w0.254: v1(20.7,9.4) 21.08,9.78 27.81,9.78 v1(30.61,6.98)
  Bottom Layer w0.254: v1(30.61,6.98) 30.57,7.02 CN2.56
PF11: length 21.5
  Top Layer w0.152: U1.49 30.1,15.79 31.41,14.48 35.81,14.48 v1(36.32,14.99)
  Inner2 w0.254: v1(36.32,14.99) 36.45,15.11 v1(36.45,26.67)
  Bottom Layer w0.152: CN2.5 36.1,27.02 v1(36.45,26.67)
PF12: length 5.4
  Top Layer w0.152: v1(31.5,15.24) 31.15,15.24 30.1,16.29 U1.50
  Bottom Layer w0.152: CN2.38 29.66,14.1 30.73,14.1 31.5,14.86 v1(31.5,15.24)
PF13: length 7.1
  Top Layer w0.152: U1.53 30.33,17.79 32.89,15.23 v1(32.89,14.99)
  Bottom Layer w0.152: v1(32.89,14.99) 33.66,14.22 CN2.37
PF14: length 8.9
  Top Layer w0.152: U1.54 28.19,18.29 27.69,18.8 v1(27.18,18.8)
  Bottom Layer w0.152: v1(27.18,18.8) 26.16,17.78 26.16,16.64 27.81,14.99 29.5,14.99 CN2.36
PF15: length 7.8
  Top Layer w0.152: v1(31.5,18.29) 30.99,18.79 U1.55
  Bottom Layer w0.152: CN2.35 33.62,15.02 31.5,17.14 v1(31.5,18.29)
PG0: length 8.6
  Top Layer w0.152: v1(26.29,18.67) 26.91,19.29 U1.56
  Inner2 w0.254: v1(26.29,18.67) 26.03,18.41 26.03,17.53 v1(27.56,16)
  Bottom Layer w0.152: v1(27.56,16) 27.74,15.82 CN2.34
PG1: length 7.7
  Top Layer w0.152: v1(32.13,17.53) 32.13,18.41 30.75,19.79 U1.57
  Bottom Layer w0.152: v1(32.13,17.53) 33.84,15.82 CN2.33
PG2: length 19.1
  Top Layer w0.152: U1.87 20.19,29.37 v1(20.19,30.48)
  Inner1 w0.254: v1(32.26,25.4) 32.26,27.69 30.61,29.34 28.96,29.34 28.45,29.84 20.83,29.84 v1(20.19,30.48)
  Bottom Layer w0.152: v1(32.26,25.4) 34.72,25.4 34.74,25.42
PG3: length 16.1
  Top Layer w0.152: v1(19.69,25.27) 19.69,29.32 U1.88
  Inner1 w0.254: v1(26.8,26.8) 25.91,27.69 24.84,27.69 21.8,24.64 20.32,24.64 v1(19.69,25.27)
  Bottom Layer w0.152: v1(26.8,26.8) 27.38,26.22 CN2.8
PG4: length 19.7
  Top Layer w0.152: v1(19.56,30.99) 19.16,30.59 U1.89
  Bottom Layer w0.152: CN2.7 33.73,26.22 28.07,31.88 24.38,31.88 23.5,30.99 v1(19.56,30.99)
PG5: length 14.2
  Top Layer w0.152: v1(19.18,26.8) 18.66,27.31 U1.90
  Inner1 w0.254: v1(19.18,26.8) 21.21,26.8 22.61,28.19 26.42,28.19 v1(27.43,27.18)
  Bottom Layer w0.152: CN2.6 27.59,27.02 v1(27.43,27.18)
PG6: length 20.8
  Top Layer w0.152: v1(8.13,28.7) 8.13,33.02 9.65,34.54 18.03,34.54 18.99,33.59 18.99,31.56 18.16,30.74 U1.91
PG7: length 27
  Top Layer w0.152: v1(7.62,32.77) 6.48,33.91 3.05,33.91 2.41,33.27 v1(2.41,28.7) ; v1(8.76,32.77) 10.29,34.29 17.65,34.29 18.67,33.27 18.67,31.62 17.66,30.62 U1.92
  Bottom Layer w0.152: v1(8.76,32.77) v1(7.62,32.77)
PG8: length 18.4
  Top Layer w0.152: U1.93 17.16,30.71 16.38,31.5 16.38,33.66 16.13,33.91 10.67,33.91 v1(8.76,32) ; v1(7.62,32) v1(7.62,27.94)
  Bottom Layer w0.152: v1(8.76,32) v1(7.62,32)
PG9: length 6.6
  Top Layer w0.152: 7.62,19.79 9.29,19.79 9.53,19.56 v1(10.54,19.56)
  Inner2 w0.254: v1(10.54,19.56) v1(10.54,18.29)
  Bottom Layer w0.152: CN1.34 10.47,18.22 v1(10.54,18.29)
PG10: length 5
  Top Layer w0.152: 7.62,19.29 5.58,19.29 v1(4.7,18.41)
  Bottom Layer w0.152: v1(4.7,18.41) 4.5,18.22 CN1.33
PG11: length 7.9
  Top Layer w0.152: 7.62,18.79 10.8,18.79 11.3,18.29 v1(11.3,17.4)
  Bottom Layer w0.152: 8.24,17.42 11.28,17.42 v1(11.3,17.4)
PG12: length 4.9
  Top Layer w0.152: v1(4.7,17.65) 5.34,18.29 7.62,18.29
  Bottom Layer w0.152: v1(4.7,17.65) 4.46,17.42 3.04,17.42
PG13: length 6.4
  Top Layer w0.152: 7.62,17.79 10.15,17.79 10.79,17.14 v1(10.79,16.76)
  Bottom Layer w0.152: CN1.30 10.65,16.62 v1(10.79,16.76)
PG14: length 4.9
  Top Layer w0.152: 7.62,17.29 5.23,17.29 v1(4.7,16.76)
  Bottom Layer w0.152: v1(4.7,16.76) 4.55,16.62 CN1.29
PG15: length 1.5
  Top Layer w0.152: 7.62,15.79 v1(9.14,15.79)
RESET: length 15.6
  Top Layer w0.152: RESET.1 28.7,4.57 29.03,4.9 R3.2 ; C19.1 27.69,2.16 v1(27.18,2.67) ; v1(21.84,5.59) 21.66,5.77 21.66,7.74
  Bottom Layer w0.152: v1(21.84,5.59) 23.5,5.59 24.76,4.32 27.05,4.32 v1(27.18,4.44) v1(27.18,2.67)
SWCLK: length 27.5
  Top Layer w0.152: v1(6.22,28.7) 6.22,27.43 6.36,27.29 7.62,27.29
  Inner1 w0.254: H1.3 13.72,31.37 11.56,31.37 10.29,30.1 6.86,30.1 6.22,29.46 v1(6.22,28.7) 5.97,28.45 4.7,28.45 2.54,30.61 v1(1.91,30.61)
  Bottom Layer w0.152: v1(1.91,30.61) 1.14,29.84 1.14,24.38 v1(1.65,23.88) 2.98,23.88 CN1.47
SWDIO: length 20.9
  Top Layer w0.152: v1(11.81,30.73) 11.48,30.73 11.16,30.42 U1.105
  Inner2 w0.254: 12.32,30.23 15.49,30.23 17.53,32.26 H1.2 ; 12.32,30.23 13.84,28.7 13.84,25.15 12.57,23.88 v1(11.43,23.88) ; 12.32,30.23 v1(11.81,30.73)
  Bottom Layer w0.152: v1(11.43,23.88) 8.29,23.88 CN1.48
VREF+: length 10.7
  Inner2 w0.254: v1(34.04,8.76) 30.86,8.76 28.45,11.18 v1(25.02,11.18)
  Bottom Layer w0.152: R2.2 v1(25.02,11.18)
$1N6098: length 8.8
  Top Layer w0.152: 25.16,7.74 25.16,8.74 23.37,10.54 23.37,11.18 22.73,11.81 19.94,11.81 v1(19.3,11.18)
  vias: v1(23.38,11.18)
$1N10038: length 3.5
  Top Layer w0.152: R4.2 4.14,30.68 v1(4.7,31.24)
  Bottom Layer w0.152: v1(4.7,31.24) 4.7,32.38 5.21,32.89
  vias: v1(5.31,32.9)

## Copper pours and planes (outline as drawn; the poured copper is in the pictures)
GND on Top Layer: -4.32,40 42.67,40 42.67,-3.3 -4.32,-3.3
GND on Bottom Layer: -9.4,43.81 47.12,43.81 47.12,-7.49 -9.4,-7.49
GND on Inner2: -6.98,41.53 45.21,41.53 45.21,-5.46 -6.98,-5.46
VCC_3V3 on Inner1: -2.29,38.35 40.64,38.35 40.64,-1.91 -2.29,-1.91
$1N14408 on Top Layer: 5.33,5.84 5.97,5.21 5.97,4.02 5.75,3.81 4.56,3.81 4.23,3.48 2.64,3.48 2.41,3.7 2.41,5.31 2.94,5.84

Small or netless copper shapes (teardrops, artwork), in the pictures only: 332 on Top Layer, 216 on Bottom Layer, 44 on Inner1, 54 on Inner2

## Text on the board
Bottom Silkscreen Layer: By : Connr.Tu | 值得拥有！ | 驴叫牌核心板 | 你！
